# EAGLE schematic Resistor_Resistor (EAGLE 8.3.0), part 8 of 43
## Parts (continued)
R10238  10K  RESISTOR_0201  [0201]
R10239  10K  RESISTOR_0201  [0201]
R10240  10K  RESISTOR_0201  [0201]
R10241  10K  RESISTOR_0201  [0201]
R10242  10K  RESISTOR_0201  [0201]
R10243  10K  RESISTOR_0201  [0201]
R10244  10K  RESISTOR_0201  [0201]
R10245  10K  RESISTOR_0201  [0201]
R10246  10K  RESISTOR_0201  [0201]
R10247  10K  RESISTOR_0201  [0201]
R10248  10K  RESISTOR_0201  [0201]
R10249  10K  RESISTOR_0201  [0201]
R10250  10K  RESISTOR_0201  [0201]
R10251  10K  RESISTOR_0201  [0201]
R10252  10K  RESISTOR_0201  [0201]
R10253  10K  RESISTOR_0201  [0201]
R10254  10K  RESISTOR_0201  [0201]
R10255  10K  RESISTOR_0201  [0201]
R10256  10K  RESISTOR_0201  [0201]
R10257  10K  RESISTOR_0201  [0201]
R10258  10K  RESISTOR_0201  [0201]
R10259  10K  RESISTOR_0201  [0201]
R10260  10K  RESISTOR_0201  [0201]
R10261  10K  RESISTOR_0201  [0201]
R10262  10K  RESISTOR_0201  [0201]
R10263  10K  RESISTOR_0201  [0201]
R10264  10K  RESISTOR_0201  [0201]
R10265  10K  RESISTOR_0201  [0201]
R10266  10K  RESISTOR_0201  [0201]
R10267  10K  RESISTOR_0201  [0201]
R10268  10K  RESISTOR_0201  [0201]
R10269  10K  RESISTOR_0201  [0201]
R10270  10K  RESISTOR_0201  [0201]
R10271  10K  RESISTOR_0201  [0201]
R10272  10K  RESISTOR_0201  [0201]
R10273  10K  RESISTOR_0201  [0201]
R10274  10K  RESISTOR_0201  [0201]
R10275  10K  RESISTOR_0201  [0201]
R10276  10K  RESISTOR_0201  [0201]
R10277  10K  RESISTOR_0201  [0201]
R10278  10K  RESISTOR_0201  [0201]
R10279  10K  RESISTOR_0201  [0201]
R10280  10K  RESISTOR_0201  [0201]
R10281  10K  RESISTOR_0201  [0201]
R10282  10K  RESISTOR_0201  [0201]
R10283  10K  RESISTOR_0201  [0201]
R10284  10K  RESISTOR_0201  [0201]
R10285  10K  RESISTOR_0201  [0201]
R10286  10K  RESISTOR_0201  [0201]
R10287  10K  RESISTOR_0201  [0201]
R10288  10K  RESISTOR_0201  [0201]
R10289  10K  RESISTOR_0201  [0201]
R10290  10K  RESISTOR_0201  [0201]
R10291  10K  RESISTOR_0201  [0201]
R10292  10K  RESISTOR_0201  [0201]
R10293  10K  RESISTOR_0201  [0201]
R10294  10K  RESISTOR_0201  [0201]
R10295  10K  RESISTOR_0201  [0201]
R10296  10K  RESISTOR_0201  [0201]
R10297  10K  RESISTOR_0201  [0201]
R10298  10K  RESISTOR_0201  [0201]
R10299  10K  RESISTOR_0201  [0201]
R10300  10K  RESISTOR_0201  [0201]
R10301  10K  RESISTOR_0201  [0201]
R10302  10K  RESISTOR_0201  [0201]
R10303  10K  RESISTOR_0201  [0201]
R10304  10K  RESISTOR_0201  [0201]
R10305  10K  RESISTOR_0201  [0201]
R10306  10K  RESISTOR_0201  [0201]
R10307  10K  RESISTOR_0201  [0201]
R10308  10K  RESISTOR_0201  [0201]
R10309  10K  RESISTOR_0201  [0201]
R10310  10K  RESISTOR_0201  [0201]
R10311  10K  RESISTOR_0201  [0201]
R10312  10K  RESISTOR_0201  [0201]
R10313  10K  RESISTOR_0201  [0201]
R10314  10K  RESISTOR_0201  [0201]
R10315  10K  RESISTOR_0201  [0201]
R10316  10K  RESISTOR_0201  [0201]
R10317  10K  RESISTOR_0201  [0201]
R10318  10K  RESISTOR_0201  [0201]
R10319  10K  RESISTOR_0201  [0201]
R10320  10K  RESISTOR_0201  [0201]
R10321  10K  RESISTOR_0201  [0201]
R10322  10K  RESISTOR_0201  [0201]
R10323  10K  RESISTOR_0201  [0201]
R10324  10K  RESISTOR_0201  [0201]
R10325  10K  RESISTOR_0201  [0201]
R10326  10K  RESISTOR_0201  [0201]
R10327  10K  RESISTOR_0201  [0201]
R10328  10K  RESISTOR_0201  [0201]
R10329  10K  RESISTOR_0201  [0201]
R10330  10K  RESISTOR_0201  [0201]
R10331  10K  RESISTOR_0201  [0201]
R10332  10K  RESISTOR_0201  [0201]
R10333  10K  RESISTOR_0201  [0201]
R10334  10K  RESISTOR_0201  [0201]
R10335  10K  RESISTOR_0201  [0201]
R10336  10K  RESISTOR_0201  [0201]
R10337  10K  RESISTOR_0201  [0201]
R10338  10K  RESISTOR_0201  [0201]
R10339  10K  RESISTOR_0201  [0201]
R10340  10K  RESISTOR_0201  [0201]
R10341  10K  RESISTOR_0201  [0201]
R10342  10K  RESISTOR_0201  [0201]
R10343  10K  RESISTOR_0201  [0201]
R10344  10K  RESISTOR_0201  [0201]
R10345  10K  RESISTOR_0201  [0201]
R10346  10K  RESISTOR_0201  [0201]
R10347  10K  RESISTOR_0201  [0201]
R10348  10K  RESISTOR_0201  [0201]
R10349  10K  RESISTOR_0201  [0201]
R10350  10K  RESISTOR_0201  [0201]
R10351  10K  RESISTOR_0201  [0201]
R10352  10K  RESISTOR_0201  [0201]
R10353  10K  RESISTOR_0201  [0201]
R10354  10K  RESISTOR_0201  [0201]
R10355  10K  RESISTOR_0201  [0201]
R10356  10K  RESISTOR_0201  [0201]
R10357  10K  RESISTOR_0201  [0201]
R10358  10K  RESISTOR_0201  [0201]
R10359  10K  RESISTOR_0201  [0201]
R10360  10K  RESISTOR_0201  [0201]
R10361  10K  RESISTOR_0201  [0201]
R10362  10K  RESISTOR_0201  [0201]
R10363  10K  RESISTOR_0201  [0201]
R10364  10K  RESISTOR_0201  [0201]
R10365  10K  RESISTOR_0201  [0201]
R10366  10K  RESISTOR_0201  [0201]
R10367  10K  RESISTOR_0201  [0201]
R10368  10K  RESISTOR_0201  [0201]
R10369  10K  RESISTOR_0201  [0201]
R10370  10K  RESISTOR_0201  [0201]
R10371  10K  RESISTOR_0201  [0201]
R10372  10K  RESISTOR_0201  [0201]
R10373  10K  RESISTOR_0201  [0201]
R10374  10K  RESISTOR_0201  [0201]
R10375  10K  RESISTOR_0201  [0201]
R10376  10K  RESISTOR_0201  [0201]
R10377  10K  RESISTOR_0201  [0201]
R10378  10K  RESISTOR_0201  [0201]
R10379  10K  RESISTOR_0201  [0201]
R10380  10K  RESISTOR_0201  [0201]
R10381  10K  RESISTOR_0201  [0201]
R10382  10K  RESISTOR_0201  [0201]
R10383  10K  RESISTOR_0201  [0201]
R10384  10K  RESISTOR_0201  [0201]
R10385  10K  RESISTOR_0201  [0201]
R10386  10K  RESISTOR_0201  [0201]
R10387  10K  RESISTOR_0201  [0201]
R10388  10K  RESISTOR_0201  [0201]
R10389  10K  RESISTOR_0201  [0201]
R10390  10K  RESISTOR_0201  [0201]
R10391  10K  RESISTOR_0201  [0201]
R10392  10K  RESISTOR_0201  [0201]
R10393  10K  RESISTOR_0201  [0201]
R10394  10K  RESISTOR_0201  [0201]
R10395  10K  RESISTOR_0201  [0201]
R10396  10K  RESISTOR_0201  [0201]
R10397  10K  RESISTOR_0201  [0201]
R10398  10K  RESISTOR_0201  [0201]
R10399  10K  RESISTOR_0201  [0201]
R10400  10K  RESISTOR_0201  [0201]
R10401  10K  RESISTOR_0201  [0201]
R10402  10K  RESISTOR_0201  [0201]
R10403  10K  RESISTOR_0201  [0201]
R10404  10K  RESISTOR_0201  [0201]
R10405  10K  RESISTOR_0201  [0201]
R10406  10K  RESISTOR_0201  [0201]
R10407  10K  RESISTOR_0201  [0201]
R10408  10K  RESISTOR_0201  [0201]
R10409  10K  RESISTOR_0201  [0201]
R10410  10K  RESISTOR_0201  [0201]
R10411  10K  RESISTOR_0201  [0201]
R10412  10K  RESISTOR_0201  [0201]
R10413  10K  RESISTOR_0201  [0201]
R10414  10K  RESISTOR_0201  [0201]
R10415  10K  RESISTOR_0201  [0201]
R10416  10K  RESISTOR_0201  [0201]
R10417  10K  RESISTOR_0201  [0201]
R10418  10K  RESISTOR_0201  [0201]
R10419  10K  RESISTOR_0201  [0201]
R10420  10K  RESISTOR_0201  [0201]
R10421  10K  RESISTOR_0201  [0201]
R10422  10K  RESISTOR_0201  [0201]
R10423  10K  RESISTOR_0201  [0201]
R10424  10K  RESISTOR_0201  [0201]
R10425  10K  RESISTOR_0201  [0201]
R10426  10K  RESISTOR_0201  [0201]
R10427  10K  RESISTOR_0201  [0201]
R10428  10K  RESISTOR_0201  [0201]
R10429  10K  RESISTOR_0201  [0201]
R10430  10K  RESISTOR_0201  [0201]
R10431  10K  RESISTOR_0201  [0201]
R10432  10K  RESISTOR_0201  [0201]
R10433  10K  RESISTOR_0201  [0201]
R10434  10K  RESISTOR_0201  [0201]
R10435  10K  RESISTOR_0201  [0201]
R10436  10K  RESISTOR_0201  [0201]
R10437  10K  RESISTOR_0201  [0201]
R10438  10K  RESISTOR_0201  [0201]
R10439  10K  RESISTOR_0201  [0201]
R10440  10K  RESISTOR_0201  [0201]
R10441  10K  RESISTOR_0201  [0201]
R10442  10K  RESISTOR_0201  [0201]
R10443  10K  RESISTOR_0201  [0201]
R10444  10K  RESISTOR_0201  [0201]
R10445  10K  RESISTOR_0201  [0201]
R10446  10K  RESISTOR_0201  [0201]
R10447  10K  RESISTOR_0201  [0201]
R10448  10K  RESISTOR_0201  [0201]
R10449  10K  RESISTOR_0201  [0201]
R10450  10K  RESISTOR_0201  [0201]
R10451  10K  RESISTOR_0201  [0201]
R10452  10K  RESISTOR_0201  [0201]
R10453  10K  RESISTOR_0201  [0201]
R10454  10K  RESISTOR_0201  [0201]
R10455  10K  RESISTOR_0201  [0201]
R10456  10K  RESISTOR_0201  [0201]
R10457  10K  RESISTOR_0201  [0201]
R10458  10K  RESISTOR_0201  [0201]
R10459  10K  RESISTOR_0201  [0201]
R10460  10K  RESISTOR_0201  [0201]
R10461  10K  RESISTOR_0201  [0201]
R10462  10K  RESISTOR_0201  [0201]
R10463  10K  RESISTOR_0201  [0201]
R10464  10K  RESISTOR_0201  [0201]
R10465  10K  RESISTOR_0201  [0201]
R10466  10K  RESISTOR_0201  [0201]
R10467  10K  RESISTOR_0201  [0201]
R10468  10K  RESISTOR_0201  [0201]
R10469  10K  RESISTOR_0201  [0201]
R10470  10K  RESISTOR_0201  [0201]
R10471  10K  RESISTOR_0201  [0201]
R10472  10K  RESISTOR_0201  [0201]
R10473  10K  RESISTOR_0201  [0201]
R10474  10K  RESISTOR_0201  [0201]
R10475  10K  RESISTOR_0201  [0201]
R10476  10K  RESISTOR_0201  [0201]
R10477  10K  RESISTOR_0201  [0201]
R10478  10K  RESISTOR_0201  [0201]
R10479  10K  RESISTOR_0201  [0201]
R10480  10K  RESISTOR_0201  [0201]
R10481  10K  RESISTOR_0201  [0201]
R10482  10K  RESISTOR_0201  [0201]
R10483  10K  RESISTOR_0201  [0201]
R10484  10K  RESISTOR_0201  [0201]
R10485  10K  RESISTOR_0201  [0201]
R10486  10K  RESISTOR_0201  [0201]
R10487  10K  RESISTOR_0201  [0201]
R10488  10K  RESISTOR_0201  [0201]
R10489  10K  RESISTOR_0201  [0201]
R10490  10K  RESISTOR_0201  [0201]
R10491  10K  RESISTOR_0201  [0201]
R10492  10K  RESISTOR_0201  [0201]
R10493  10K  RESISTOR_0201  [0201]
R10494  10K  RESISTOR_0201  [0201]
R10495  10K  RESISTOR_0201  [0201]
R10496  10K  RESISTOR_0201  [0201]
R10497  10K  RESISTOR_0201  [0201]
R10498  10K  RESISTOR_0201  [0201]
R10499  10K  RESISTOR_0201  [0201]
R10500  10K  RESISTOR_0201  [0201]
R10501  10K  RESISTOR_0201  [0201]
R10502  10K  RESISTOR_0201  [0201]
R10503  10K  RESISTOR_0201  [0201]
R10504  10K  RESISTOR_0201  [0201]
R10505  10K  RESISTOR_0201  [0201]
R10506  10K  RESISTOR_0201  [0201]
R10507  10K  RESISTOR_0201  [0201]
R10508  10K  RESISTOR_0201  [0201]
R10509  10K  RESISTOR_0201  [0201]
R10510  10K  RESISTOR_0201  [0201]
R10511  10K  RESISTOR_0201  [0201]
R10512  10K  RESISTOR_0201  [0201]
R10513  10K  RESISTOR_0201  [0201]
R10514  10K  RESISTOR_0201  [0201]
R10515  10K  RESISTOR_0201  [0201]
R10516  10K  RESISTOR_0201  [0201]
R10517  10K  RESISTOR_0201  [0201]
R10518  10K  RESISTOR_0201  [0201]
R10519  10K  RESISTOR_0201  [0201]
R10520  10K  RESISTOR_0201  [0201]
R10521  10K  RESISTOR_0201  [0201]
R10522  10K  RESISTOR_0201  [0201]
R10523  10K  RESISTOR_0201  [0201]
R10524  10K  RESISTOR_0201  [0201]
R10525  10K  RESISTOR_0201  [0201]
R10526  10K  RESISTOR_0201  [0201]
R10527  10K  RESISTOR_0201  [0201]
R10528  10K  RESISTOR_0201  [0201]
R10529  10K  RESISTOR_0201  [0201]
R10530  10K  RESISTOR_0201  [0201]
R10531  10K  RESISTOR_0201  [0201]
R10532  10K  RESISTOR_0201  [0201]
R10533  10K  RESISTOR_0201  [0201]
R10534  10K  RESISTOR_0201  [0201]
R10535  10K  RESISTOR_0201  [0201]
R10536  10K  RESISTOR_0201  [0201]
R10537  10K  RESISTOR_0201  [0201]
R10538  10K  RESISTOR_0201  [0201]
R10539  10K  RESISTOR_0201  [0201]
R10540  10K  RESISTOR_0201  [0201]
R10541  10K  RESISTOR_0201  [0201]
R10542  10K  RESISTOR_0201  [0201]
R10543  10K  RESISTOR_0201  [0201]
R10544  10K  RESISTOR_0201  [0201]
R10545  10K  RESISTOR_0201  [0201]
R10546  10K  RESISTOR_0201  [0201]
R10547  10K  RESISTOR_0201  [0201]
R10548  10K  RESISTOR_0201  [0201]
R10549  10K  RESISTOR_0201  [0201]
R10550  10K  RESISTOR_0201  [0201]
R10551  10K  RESISTOR_0201  [0201]
R10552  10K  RESISTOR_0201  [0201]
R10553  10K  RESISTOR_0201  [0201]
R10554  10K  RESISTOR_0201  [0201]
R10555  10K  RESISTOR_0201  [0201]
R10556  10K  RESISTOR_0201  [0201]
R10557  10K  RESISTOR_0201  [0201]
R10558  10K  RESISTOR_0201  [0201]
R10559  10K  RESISTOR_0201  [0201]
R10560  10K  RESISTOR_0201  [0201]
R10561  10K  RESISTOR_0201  [0201]
R10562  10K  RESISTOR_0201  [0201]
R10563  10K  RESISTOR_0201  [0201]
R10564  10K  RESISTOR_0201  [0201]
R10565  10K  RESISTOR_0201  [0201]
R10566  10K  RESISTOR_0201  [0201]
R10567  10K  RESISTOR_0201  [0201]
R10568  10K  RESISTOR_0201  [0201]
R10569  10K  RESISTOR_0201  [0201]
R10570  10K  RESISTOR_0201  [0201]
R10571  10K  RESISTOR_0201  [0201]
R10572  10K  RESISTOR_0201  [0201]
R10573  10K  RESISTOR_0201  [0201]
R10574  10K  RESISTOR_0201  [0201]
R10575  10K  RESISTOR_0201  [0201]
R10576  10K  RESISTOR_0201  [0201]
R10577  10K  RESISTOR_0201  [0201]
R10578  10K  RESISTOR_0201  [0201]
R10579  10K  RESISTOR_0201  [0201]
R10580  10K  RESISTOR_0201  [0201]
R10581  10K  RESISTOR_0201  [0201]
R10582  10K  RESISTOR_0201  [0201]
R10583  10K  RESISTOR_0201  [0201]
R10584  10K  RESISTOR_0201  [0201]
R10585  10K  RESISTOR_0201  [0201]
R10586  10K  RESISTOR_0201  [0201]
R10587  10K  RESISTOR_0201  [0201]
R10588  10K  RESISTOR_0201  [0201]
R10589  10K  RESISTOR_0201  [0201]
R10590  10K  RESISTOR_0201  [0201]
R10591  10K  RESISTOR_0201  [0201]
R10592  10K  RESISTOR_0201  [0201]
R10593  10K  RESISTOR_0201  [0201]
R10594  10K  RESISTOR_0201  [0201]
R10595  10K  RESISTOR_0201  [0201]
R10596  10K  RESISTOR_0201  [0201]
R10597  10K  RESISTOR_0201  [0201]
R10598  10K  RESISTOR_0201  [0201]
R10599  10K  RESISTOR_0201  [0201]
R10600  10K  RESISTOR_0201  [0201]
R10601  10K  RESISTOR_0201  [0201]
R10602  10K  RESISTOR_0201  [0201]
R10603  10K  RESISTOR_0201  [0201]
R10604  10K  RESISTOR_0201  [0201]
R10605  10K  RESISTOR_0201  [0201]
R10606  10K  RESISTOR_0201  [0201]
R10607  10K  RESISTOR_0201  [0201]
R10608  10K  RESISTOR_0201  [0201]
R10609  10K  RESISTOR_0201  [0201]
R10610  10K  RESISTOR_0201  [0201]
R10611  10K  RESISTOR_0201  [0201]
R10612  10K  RESISTOR_0201  [0201]
R10613  10K  RESISTOR_0201  [0201]
R10614  10K  RESISTOR_0201  [0201]
R10615  10K  RESISTOR_0201  [0201]
R10616  10K  RESISTOR_0201  [0201]
R10617  10K  RESISTOR_0201  [0201]
R10618  10K  RESISTOR_0201  [0201]
R10619  10K  RESISTOR_0201  [0201]
R10620  10K  RESISTOR_0201  [0201]
R10621  10K  RESISTOR_0201  [0201]
R10622  10K  RESISTOR_0201  [0201]
R10623  10K  RESISTOR_0201  [0201]
R10624  10K  RESISTOR_0201  [0201]
R10625  10K  RESISTOR_0201  [0201]
R10626  10K  RESISTOR_0201  [0201]
R10627  10K  RESISTOR_0201  [0201]
R10628  10K  RESISTOR_0201  [0201]
R10629  10K  RESISTOR_0201  [0201]
R10630  10K  RESISTOR_0201  [0201]
R10631  10K  RESISTOR_0201  [0201]
R10632  10K  RESISTOR_0201  [0201]
R10633  10K  RESISTOR_0201  [0201]
R10634  10K  RESISTOR_0201  [0201]
R10635  10K  RESISTOR_0201  [0201]
R10636  10K  RESISTOR_0201  [0201]
R10637  10K  RESISTOR_0201  [0201]
R10638  10K  RESISTOR_0201  [0201]
R10639  10K  RESISTOR_0201  [0201]
R10640  10K  RESISTOR_0201  [0201]
R10641  10K  RESISTOR_0201  [0201]
R10642  10K  RESISTOR_0201  [0201]
R10643  10K  RESISTOR_0201  [0201]
R10644  10K  RESISTOR_0201  [0201]
R10645  10K  RESISTOR_0201  [0201]
R10646  10K  RESISTOR_0201  [0201]
R10647  10K  RESISTOR_0201  [0201]
R10648  10K  RESISTOR_0201  [0201]
R10649  10K  RESISTOR_0201  [0201]
R10650  10K  RESISTOR_0201  [0201]
R10651  10K  RESISTOR_0201  [0201]
R10652  10K  RESISTOR_0201  [0201]
R10653  10K  RESISTOR_0201  [0201]
R10654  10K  RESISTOR_0201  [0201]
R10655  10K  RESISTOR_0201  [0201]
R10656  10K  RESISTOR_0201  [0201]
R10657  10K  RESISTOR_0201  [0201]
R10658  10K  RESISTOR_0201  [0201]
R10659  10K  RESISTOR_0201  [0201]
R10660  10K  RESISTOR_0201  [0201]
R10661  10K  RESISTOR_0201  [0201]
R10662  10K  RESISTOR_0201  [0201]
R10663  10K  RESISTOR_0201  [0201]
R10664  10K  RESISTOR_0201  [0201]
R10665  10K  RESISTOR_0201  [0201]
R10666  10K  RESISTOR_0201  [0201]
R10667  10K  RESISTOR_0201  [0201]
R10668  10K  RESISTOR_0201  [0201]
R10669  10K  RESISTOR_0201  [0201]
R10670  10K  RESISTOR_0201  [0201]
R10671  10K  RESISTOR_0201  [0201]
R10672  10K  RESISTOR_0201  [0201]
R10673  10K  RESISTOR_0201  [0201]
R10674  10K  RESISTOR_0201  [0201]
R10675  10K  RESISTOR_0201  [0201]
R10676  10K  RESISTOR_0201  [0201]
R10677  10K  RESISTOR_0201  [0201]
R10678  10K  RESISTOR_0201  [0201]
R10679  10K  RESISTOR_0201  [0201]
R10680  10K  RESISTOR_0201  [0201]
R10681  10K  RESISTOR_0201  [0201]
R10682  10K  RESISTOR_0201  [0201]
R10683  10K  RESISTOR_0201  [0201]
R10684  10K  RESISTOR_0201  [0201]
R10685  10K  RESISTOR_0201  [0201]
R10686  10K  RESISTOR_0201  [0201]
R10687  10K  RESISTOR_0201  [0201]
R10688  10K  RESISTOR_0201  [0201]
R10689  10K  RESISTOR_0201  [0201]
R10690  10K  RESISTOR_0201  [0201]
R10691  10K  RESISTOR_0201  [0201]
R10692  10K  RESISTOR_0201  [0201]
R10693  10K  RESISTOR_0201  [0201]
R10694  10K  RESISTOR_0201  [0201]
R10695  10K  RESISTOR_0201  [0201]
R10696  10K  RESISTOR_0201  [0201]
R10697  10K  RESISTOR_0201  [0201]
R10698  10K  RESISTOR_0201  [0201]
R10699  10K  RESISTOR_0201  [0201]
R10700  10K  RESISTOR_0201  [0201]
R10701  10K  RESISTOR_0201  [0201]
R10702  10K  RESISTOR_0201  [0201]
R10703  10K  RESISTOR_0201  [0201]
R10704  10K  RESISTOR_0201  [0201]
R10705  10K  RESISTOR_0201  [0201]
R10706  10K  RESISTOR_0201  [0201]
R10707  10K  RESISTOR_0201  [0201]
R10708  10K  RESISTOR_0201  [0201]
R10709  10K  RESISTOR_0201  [0201]
R10710  10K  RESISTOR_0201  [0201]
R10711  10K  RESISTOR_0201  [0201]
R10712  10K  RESISTOR_0201  [0201]
R10713  10K  RESISTOR_0201  [0201]
R10714  10K  RESISTOR_0201  [0201]
R10715  10K  RESISTOR_0201  [0201]
R10716  10K  RESISTOR_0201  [0201]
R10717  10K  RESISTOR_0201  [0201]
R10718  10K  RESISTOR_0201  [0201]
R10719  10K  RESISTOR_0201  [0201]
R10720  10K  RESISTOR_0201  [0201]
R10721  10K  RESISTOR_0201  [0201]
R10722  10K  RESISTOR_0201  [0201]
R10723  10K  RESISTOR_0201  [0201]
R10724  10K  RESISTOR_0201  [0201]
R10725  10K  RESISTOR_0201  [0201]
R10726  10K  RESISTOR_0201  [0201]
R10727  10K  RESISTOR_0201  [0201]
R10728  10K  RESISTOR_0201  [0201]
R10729  10K  RESISTOR_0201  [0201]
R10730  10K  RESISTOR_0201  [0201]
R10731  10K  RESISTOR_0201  [0201]
R10732  10K  RESISTOR_0201  [0201]
R10733  10K  RESISTOR_0201  [0201]
R10734  10K  RESISTOR_0201  [0201]
R10735  10K  RESISTOR_0201  [0201]
R10736  10K  RESISTOR_0201  [0201]
R10737  10K  RESISTOR_0201  [0201]
R10738  10K  RESISTOR_0201  [0201]
R10739  10K  RESISTOR_0201  [0201]
R10740  10K  RESISTOR_0201  [0201]
R10741  10K  RESISTOR_0201  [0201]
R10742  10K  RESISTOR_0201  [0201]
R10743  10K  RESISTOR_0201  [0201]
R10744  10K  RESISTOR_0201  [0201]
R10745  10K  RESISTOR_0201  [0201]
R10746  10K  RESISTOR_0201  [0201]
R10747  10K  RESISTOR_0201  [0201]
R10748  10K  RESISTOR_0201  [0201]
R10749  10K  RESISTOR_0201  [0201]
R10750  10K  RESISTOR_0201  [0201]
R10751  10K  RESISTOR_0201  [0201]
R10752  10K  RESISTOR_0201  [0201]
R10753  10K  RESISTOR_0201  [0201]
R10754  10K  RESISTOR_0201  [0201]
R10755  10K  RESISTOR_0201  [0201]
R10756  10K  RESISTOR_0201  [0201]
R10757  10K  RESISTOR_0201  [0201]
R10758  10K  RESISTOR_0201  [0201]
R10759  10K  RESISTOR_0201  [0201]
R10760  10K  RESISTOR_0201  [0201]
R10761  10K  RESISTOR_0201  [0201]
R10762  10K  RESISTOR_0201  [0201]
R10763  10K  RESISTOR_0201  [0201]
R10764  10K  RESISTOR_0201  [0201]
R10765  10K  RESISTOR_0201  [0201]
R10766  10K  RESISTOR_0201  [0201]
R10767  10K  RESISTOR_0201  [0201]
R10768  10K  RESISTOR_0201  [0201]
R10769  10K  RESISTOR_0201  [0201]
R10770  10K  RESISTOR_0201  [0201]
R10771  10K  RESISTOR_0201  [0201]
R10772  10K  RESISTOR_0201  [0201]
R10773  10K  RESISTOR_0201  [0201]
R10774  10K  RESISTOR_0201  [0201]
R10775  10K  RESISTOR_0201  [0201]
R10776  10K  RESISTOR_0201  [0201]
R10777  10K  RESISTOR_0201  [0201]
R10778  10K  RESISTOR_0201  [0201]
R10779  10K  RESISTOR_0201  [0201]
R10780  10K  RESISTOR_0201  [0201]
R10781  10K  RESISTOR_0201  [0201]
R10782  10K  RESISTOR_0201  [0201]
R10783  10K  RESISTOR_0201  [0201]
R10784  10K  RESISTOR_0201  [0201]
R10785  10K  RESISTOR_0201  [0201]
R10786  10K  RESISTOR_0201  [0201]
R10787  10K  RESISTOR_0201  [0201]
R10788  10K  RESISTOR_0201  [0201]
R10789  10K  RESISTOR_0201  [0201]
R10790  10K  RESISTOR_0201  [0201]
R10791  10K  RESISTOR_0201  [0201]
R10792  10K  RESISTOR_0201  [0201]
R10793  10K  RESISTOR_0201  [0201]
R10794  10K  RESISTOR_0201  [0201]
R10795  10K  RESISTOR_0201  [0201]
R10796  10K  RESISTOR_0201  [0201]
R10797  10K  RESISTOR_0201  [0201]
R10798  10K  RESISTOR_0201  [0201]
R10799  10K  RESISTOR_0201  [0201]
R10800  10K  RESISTOR_0201  [0201]
R10801  10K  RESISTOR_0201  [0201]
R10802  10K  RESISTOR_0201  [0201]
R10803  10K  RESISTOR_0201  [0201]
R10804  10K  RESISTOR_0201  [0201]
R10805  10K  RESISTOR_0201  [0201]
R10806  10K  RESISTOR_0201  [0201]
R10807  10K  RESISTOR_0201  [0201]
R10808  10K  RESISTOR_0201  [0201]
R10809  10K  RESISTOR_0201  [0201]
R10810  10K  RESISTOR_0201  [0201]
R10811  10K  RESISTOR_0201  [0201]
R10812  10K  RESISTOR_0201  [0201]
R10813  10K  RESISTOR_0201  [0201]
R10814  10K  RESISTOR_0201  [0201]
R10815  10K  RESISTOR_0201  [0201]
R10816  10K  RESISTOR_0201  [0201]
R10817  10K  RESISTOR_0201  [0201]
R10818  10K  RESISTOR_0201  [0201]
R10819  10K  RESISTOR_0201  [0201]
R10820  10K  RESISTOR_0201  [0201]
R10821  10K  RESISTOR_0201  [0201]
R10822  10K  RESISTOR_0201  [0201]
R10823  10K  RESISTOR_0201  [0201]
R10824  10K  RESISTOR_0201  [0201]
R10825  10K  RESISTOR_0201  [0201]
R10826  10K  RESISTOR_0201  [0201]
R10827  10K  RESISTOR_0201  [0201]
R10828  10K  RESISTOR_0201  [0201]
R10829  10K  RESISTOR_0201  [0201]
R10830  10K  RESISTOR_0201  [0201]
R10831  10K  RESISTOR_0201  [0201]
R10832  10K  RESISTOR_0201  [0201]
R10833  10K  RESISTOR_0201  [0201]
R10834  10K  RESISTOR_0201  [0201]
R10835  10K  RESISTOR_0201  [0201]
R10836  10K  RESISTOR_0201  [0201]
R10837  10K  RESISTOR_0201  [0201]
R10838  10K  RESISTOR_0201  [0201]
R10839  10K  RESISTOR_0201  [0201]
R10840  10K  RESISTOR_0201  [0201]
R10841  10K  RESISTOR_0201  [0201]
R10842  10K  RESISTOR_0201  [0201]
R10843  10K  RESISTOR_0201  [0201]
R10844  10K  RESISTOR_0201  [0201]
R10845  10K  RESISTOR_0201  [0201]
R10846  10K  RESISTOR_0201  [0201]
R10847  10K  RESISTOR_0201  [0201]
R10848  10K  RESISTOR_0201  [0201]
R10849  10K  RESISTOR_0201  [0201]
R10850  10K  RESISTOR_0201  [0201]
R10851  10K  RESISTOR_0201  [0201]
R10852  10K  RESISTOR_0201  [0201]
R10853  10K  RESISTOR_0201  [0201]
R10854  10K  RESISTOR_0201  [0201]
R10855  10K  RESISTOR_0201  [0201]
R10856  10K  RESISTOR_0201  [0201]
R10857  10K  RESISTOR_0201  [0201]
R10858  10K  RESISTOR_0201  [0201]
R10859  10K  RESISTOR_0201  [0201]
R10860  10K  RESISTOR_0201  [0201]
R10861  10K  RESISTOR_0201  [0201]
R10862  10K  RESISTOR_0201  [0201]
R10863  10K  RESISTOR_0201  [0201]
R10864  10K  RESISTOR_0201  [0201]
R10865  10K  RESISTOR_0201  [0201]
R10866  10K  RESISTOR_0201  [0201]
R10867  10K  RESISTOR_0201  [0201]
R10868  10K  RESISTOR_0201  [0201]
R10869  10K  RESISTOR_0201  [0201]
R10870  10K  RESISTOR_0201  [0201]
R10871  10K  RESISTOR_0201  [0201]
R10872  10K  RESISTOR_0201  [0201]
R10873  10K  RESISTOR_0201  [0201]
R10874  10K  RESISTOR_0201  [0201]
R10875  10K  RESISTOR_0201  [0201]
R10876  10K  RESISTOR_0201  [0201]
R10877  10K  RESISTOR_0201  [0201]
R10878  10K  RESISTOR_0201  [0201]
R10879  10K  RESISTOR_0201  [0201]
R10880  10K  RESISTOR_0201  [0201]
R10881  10K  RESISTOR_0201  [0201]
R10882  10K  RESISTOR_0201  [0201]
R10883  10K  RESISTOR_0201  [0201]
R10884  10K  RESISTOR_0201  [0201]
R10885  10K  RESISTOR_0201  [0201]
R10886  10K  RESISTOR_0201  [0201]
R10887  10K  RESISTOR_0201  [0201]
R10888  10K  RESISTOR_0201  [0201]
R10889  10K  RESISTOR_0201  [0201]
R10890  10K  RESISTOR_0201  [0201]
R10891  10K  RESISTOR_0201  [0201]
R10892  10K  RESISTOR_0201  [0201]
R10893  10K  RESISTOR_0201  [0201]
R10894  10K  RESISTOR_0201  [0201]
R10895  10K  RESISTOR_0201  [0201]
R10896  10K  RESISTOR_0201  [0201]
R10897  10K  RESISTOR_0201  [0201]
R10898  10K  RESISTOR_0201  [0201]
R10899  10K  RESISTOR_0201  [0201]
R10900  10K  RESISTOR_0201  [0201]
R10901  10K  RESISTOR_0201  [0201]
R10902  10K  RESISTOR_0201  [0201]
R10903  10K  RESISTOR_0201  [0201]
R10904  10K  RESISTOR_0201  [0201]
R10905  10K  RESISTOR_0201  [0201]
R10906  10K  RESISTOR_0201  [0201]
R10907  10K  RESISTOR_0201  [0201]
R10908  10K  RESISTOR_0201  [0201]
R10909  10K  RESISTOR_0201  [0201]
R10910  10K  RESISTOR_0201  [0201]
R10911  10K  RESISTOR_0201  [0201]
R10912  10K  RESISTOR_0201  [0201]
R10913  10K  RESISTOR_0201  [0201]
R10914  10K  RESISTOR_0201  [0201]
R10915  10K  RESISTOR_0201  [0201]
R10916  10K  RESISTOR_0201  [0201]
R10917  10K  RESISTOR_0201  [0201]
R10918  10K  RESISTOR_0201  [0201]
R10919  10K  RESISTOR_0201  [0201]
R10920  10K  RESISTOR_0201  [0201]
R10921  10K  RESISTOR_0201  [0201]
R10922  10K  RESISTOR_0201  [0201]
R10923  10K  RESISTOR_0201  [0201]
R10924  10K  RESISTOR_0201  [0201]
R10925  10K  RESISTOR_0201  [0201]
R10926  10K  RESISTOR_0201  [0201]
R10927  10K  RESISTOR_0201  [0201]
R10928  10K  RESISTOR_0201  [0201]
R10929  10K  RESISTOR_0201  [0201]
R10930  10K  RESISTOR_0201  [0201]
R10931  10K  RESISTOR_0201  [0201]
R10932  10K  RESISTOR_0201  [0201]
R10933  10K  RESISTOR_0201  [0201]
R10934  10K  RESISTOR_0201  [0201]
R10935  10K  RESISTOR_0201  [0201]
R10936  10K  RESISTOR_0201  [0201]
R10937  10K  RESISTOR_0201  [0201]
R10938  10K  RESISTOR_0201  [0201]
R10939  10K  RESISTOR_0201  [0201]
R10940  10K  RESISTOR_0201  [0201]
R10941  10K  RESISTOR_0201  [0201]
R10942  10K  RESISTOR_0201  [0201]
R10943  10K  RESISTOR_0201  [0201]
R10944  10K  RESISTOR_0201  [0201]
R10945  10K  RESISTOR_0201  [0201]
R10946  10K  RESISTOR_0201  [0201]
R10947  10K  RESISTOR_0201  [0201]
R10948  10K  RESISTOR_0201  [0201]
R10949  10K  RESISTOR_0201  [0201]
R10950  10K  RESISTOR_0201  [0201]
R10951  10K  RESISTOR_0201  [0201]
R10952  10K  RESISTOR_0201  [0201]
R10953  10K  RESISTOR_0201  [0201]
R10954  10K  RESISTOR_0201  [0201]
R10955  10K  RESISTOR_0201  [0201]
R10956  10K  RESISTOR_0201  [0201]
R10957  10K  RESISTOR_0201  [0201]
R10958  10K  RESISTOR_0201  [0201]
R10959  10K  RESISTOR_0201  [0201]
R10960  10K  RESISTOR_0201  [0201]
R10961  10K  RESISTOR_0201  [0201]
R10962  10K  RESISTOR_0201  [0201]
R10963  10K  RESISTOR_0201  [0201]
R10964  10K  RESISTOR_0201  [0201]
R10965  10K  RESISTOR_0201  [0201]
R10966  10K  RESISTOR_0201  [0201]
R10967  10K  RESISTOR_0201  [0201]
R10968  10K  RESISTOR_0201  [0201]
R10969  10K  RESISTOR_0201  [0201]
R10970  10K  RESISTOR_0201  [0201]
R10971  10K  RESISTOR_0201  [0201]
R10972  10K  RESISTOR_0201  [0201]
R10973  10K  RESISTOR_0201  [0201]
R10974  10K  RESISTOR_0201  [0201]
R10975  10K  RESISTOR_0201  [0201]
R10976  10K  RESISTOR_0201  [0201]
R10977  10K  RESISTOR_0201  [0201]
R10978  10K  RESISTOR_0201  [0201]
R10979  10K  RESISTOR_0201  [0201]
R10980  10K  RESISTOR_0201  [0201]
R10981  10K  RESISTOR_0201  [0201]
R10982  10K  RESISTOR_0201  [0201]
R10983  10K  RESISTOR_0201  [0201]
R10984  10K  RESISTOR_0201  [0201]
R10985  10K  RESISTOR_0201  [0201]
R10986  10K  RESISTOR_0201  [0201]
R10987  10K  RESISTOR_0201  [0201]
R10988  10K  RESISTOR_0201  [0201]
R10989  10K  RESISTOR_0201  [0201]
R10990  10K  RESISTOR_0201  [0201]
R10991  10K  RESISTOR_0201  [0201]
R10992  10K  RESISTOR_0201  [0201]
R10993  10K  RESISTOR_0201  [0201]
R10994  10K  RESISTOR_0201  [0201]
R10995  10K  RESISTOR_0201  [0201]
R10996  10K  RESISTOR_0201  [0201]
R10997  10K  RESISTOR_0201  [0201]
R10998  10K  RESISTOR_0201  [0201]
R10999  10K  RESISTOR_0201  [0201]
R11000  10K  RESISTOR_0201  [0201]
R11001  10K  RESISTOR_0201  [0201]
R11002  10K  RESISTOR_0201  [0201]
R11003  10K  RESISTOR_0201  [0201]
R11004  10K  RESISTOR_0201  [0201]
R11005  10K  RESISTOR_0201  [0201]
R11006  10K  RESISTOR_0201  [0201]
R11007  10K  RESISTOR_0201  [0201]
R11008  10K  RESISTOR_0201  [0201]
R11009  10K  RESISTOR_0201  [0201]
R11010  10K  RESISTOR_0201  [0201]
R11011  10K  RESISTOR_0201  [0201]
R11012  10K  RESISTOR_0201  [0201]
R11013  10K  RESISTOR_0201  [0201]
R11014  10K  RESISTOR_0201  [0201]
R11015  10K  RESISTOR_0201  [0201]
R11016  10K  RESISTOR_0201  [0201]
R11017  10K  RESISTOR_0201  [0201]
R11018  10K  RESISTOR_0201  [0201]
R11019  10K  RESISTOR_0201  [0201]
R11020  10K  RESISTOR_0201  [0201]
R11021  10K  RESISTOR_0201  [0201]
R11022  10K  RESISTOR_0201  [0201]
R11023  10K  RESISTOR_0201  [0201]
R11024  10K  RESISTOR_0201  [0201]
R11025  10K  RESISTOR_0201  [0201]
R11026  10K  RESISTOR_0201  [0201]
R11027  10K  RESISTOR_0201  [0201]
R11028  10K  RESISTOR_0201  [0201]
R11029  10K  RESISTOR_0201  [0201]
R11030  10K  RESISTOR_0201  [0201]
R11031  10K  RESISTOR_0201  [0201]
R11032  10K  RESISTOR_0201  [0201]
R11033  10K  RESISTOR_0201  [0201]
R11034  10K  RESISTOR_0201  [0201]
R11035  10K  RESISTOR_0201  [0201]
R11036  10K  RESISTOR_0201  [0201]
R11037  10K  RESISTOR_0201  [0201]
R11038  10K  RESISTOR_0201  [0201]
R11039  10K  RESISTOR_0201  [0201]
R11040  10K  RESISTOR_0201  [0201]
R11041  10K  RESISTOR_0201  [0201]
R11042  10K  RESISTOR_0201  [0201]
R11043  10K  RESISTOR_0201  [0201]
R11044  10K  RESISTOR_0201  [0201]
R11045  10K  RESISTOR_0201  [0201]
R11046  10K  RESISTOR_0201  [0201]
R11047  10K  RESISTOR_0201  [0201]
R11048  10K  RESISTOR_0201  [0201]
R11049  10K  RESISTOR_0201  [0201]
R11050  10K  RESISTOR_0201  [0201]
R11051  10K  RESISTOR_0201  [0201]
R11052  10K  RESISTOR_0201  [0201]
R11053  10K  RESISTOR_0201  [0201]
R11054  10K  RESISTOR_0201  [0201]
R11055  10K  RESISTOR_0201  [0201]
R11056  10K  RESISTOR_0201  [0201]
R11057  10K  RESISTOR_0201  [0201]
R11058  10K  RESISTOR_0201  [0201]
R11059  10K  RESISTOR_0201  [0201]
R11060  10K  RESISTOR_0201  [0201]
R11061  10K  RESISTOR_0201  [0201]
R11062  10K  RESISTOR_0201  [0201]
R11063  10K  RESISTOR_0201  [0201]
R11064  10K  RESISTOR_0201  [0201]
R11065  10K  RESISTOR_0201  [0201]
R11066  10K  RESISTOR_0201  [0201]
R11067  10K  RESISTOR_0201  [0201]
R11068  10K  RESISTOR_0201  [0201]
R11069  10K  RESISTOR_0201  [0201]
R11070  10K  RESISTOR_0201  [0201]
R11071  10K  RESISTOR_0201  [0201]
R11072  10K  RESISTOR_0201  [0201]
R11073  10K  RESISTOR_0201  [0201]
R11074  10K  RESISTOR_0201  [0201]
R11075  10K  RESISTOR_0201  [0201]
R11076  10K  RESISTOR_0201  [0201]
R11077  10K  RESISTOR_0201  [0201]
R11078  10K  RESISTOR_0201  [0201]
R11079  10K  RESISTOR_0201  [0201]
R11080  10K  RESISTOR_0201  [0201]
R11081  10K  RESISTOR_0201  [0201]
R11082  10K  RESISTOR_0201  [0201]
R11083  10K  RESISTOR_0201  [0201]
R11084  10K  RESISTOR_0201  [0201]
R11085  10K  RESISTOR_0201  [0201]
R11086  10K  RESISTOR_0201  [0201]
R11087  10K  RESISTOR_0201  [0201]
R11088  10K  RESISTOR_0201  [0201]
R11089  10K  RESISTOR_0201  [0201]
R11090  10K  RESISTOR_0201  [0201]
R11091  10K  RESISTOR_0201  [0201]
R11092  10K  RESISTOR_0201  [0201]
R11093  10K  RESISTOR_0201  [0201]
R11094  10K  RESISTOR_0201  [0201]
R11095  10K  RESISTOR_0201  [0201]
R11096  10K  RESISTOR_0201  [0201]
R11097  10K  RESISTOR_0201  [0201]
R11098  10K  RESISTOR_0201  [0201]
R11099  10K  RESISTOR_0201  [0201]
R11100  10K  RESISTOR_0201  [0201]
R11101  10K  RESISTOR_0201  [0201]
R11102  10K  RESISTOR_0201  [0201]
R11103  10K  RESISTOR_0201  [0201]
R11104  10K  RESISTOR_0201  [0201]
R11105  10K  RESISTOR_0201  [0201]
R11106  10K  RESISTOR_0201  [0201]
R11107  10K  RESISTOR_0201  [0201]
R11108  10K  RESISTOR_0201  [0201]
R11109  10K  RESISTOR_0201  [0201]
R11110  10K  RESISTOR_0201  [0201]
R11111  10K  RESISTOR_0201  [0201]
R11112  10K  RESISTOR_0201  [0201]
R11113  10K  RESISTOR_0201  [0201]
R11114  10K  RESISTOR_0201  [0201]
R11115  10K  RESISTOR_0201  [0201]
R11116  10K  RESISTOR_0201  [0201]
R11117  10K  RESISTOR_0201  [0201]
R11118  10K  RESISTOR_0201  [0201]
R11119  10K  RESISTOR_0201  [0201]
R11120  10K  RESISTOR_0201  [0201]
R11121  10K  RESISTOR_0201  [0201]
R11122  10K  RESISTOR_0201  [0201]
R11123  10K  RESISTOR_0201  [0201]
R11124  10K  RESISTOR_0201  [0201]
R11125  10K  RESISTOR_0201  [0201]
R11126  10K  RESISTOR_0201  [0201]
R11127  10K  RESISTOR_0201  [0201]
R11128  10K  RESISTOR_0201  [0201]
R11129  10K  RESISTOR_0201  [0201]
R11130  10K  RESISTOR_0201  [0201]
R11131  10K  RESISTOR_0201  [0201]
R11132  10K  RESISTOR_0201  [0201]
R11133  10K  RESISTOR_0201  [0201]
R11134  10K  RESISTOR_0201  [0201]
R11135  10K  RESISTOR_0201  [0201]
R11136  10K  RESISTOR_0201  [0201]
R11137  10K  RESISTOR_0201  [0201]
R11138  10K  RESISTOR_0201  [0201]
R11139  10K  RESISTOR_0201  [0201]
R11140  10K  RESISTOR_0201  [0201]
R11141  10K  RESISTOR_0201  [0201]
R11142  10K  RESISTOR_0201  [0201]
R11143  10K  RESISTOR_0201  [0201]
R11144  10K  RESISTOR_0201  [0201]
R11145  10K  RESISTOR_0201  [0201]
R11146  10K  RESISTOR_0201  [0201]
R11147  10K  RESISTOR_0201  [0201]
R11148  10K  RESISTOR_0201  [0201]
R11149  10K  RESISTOR_0201  [0201]
R11150  10K  RESISTOR_0201  [0201]
R11151  10K  RESISTOR_0201  [0201]
R11152  10K  RESISTOR_0201  [0201]
R11153  10K  RESISTOR_0201  [0201]
R11154  10K  RESISTOR_0201  [0201]
R11155  10K  RESISTOR_0201  [0201]
R11156  10K  RESISTOR_0201  [0201]
R11157  10K  RESISTOR_0201  [0201]
R11158  10K  RESISTOR_0201  [0201]
R11159  10K  RESISTOR_0201  [0201]
R11160  10K  RESISTOR_0201  [0201]
R11161  10K  RESISTOR_0201  [0201]
R11162  10K  RESISTOR_0201  [0201]
R11163  10K  RESISTOR_0201  [0201]
R11164  10K  RESISTOR_0201  [0201]
R11165  10K  RESISTOR_0201  [0201]
R11166  10K  RESISTOR_0201  [0201]
R11167  10K  RESISTOR_0201  [0201]
R11168  10K  RESISTOR_0201  [0201]
R11169  10K  RESISTOR_0201  [0201]
R11170  10K  RESISTOR_0201  [0201]
R11171  10K  RESISTOR_0201  [0201]
R11172  10K  RESISTOR_0201  [0201]
R11173  10K  RESISTOR_0201  [0201]
R11174  10K  RESISTOR_0201  [0201]
R11175  10K  RESISTOR_0201  [0201]
R11176  10K  RESISTOR_0201  [0201]
R11177  10K  RESISTOR_0201  [0201]
R11178  10K  RESISTOR_0201  [0201]
R11179  10K  RESISTOR_0201  [0201]
R11180  10K  RESISTOR_0201  [0201]
R11181  10K  RESISTOR_0201  [0201]
R11182  10K  RESISTOR_0201  [0201]
R11183  10K  RESISTOR_0201  [0201]
R11184  10K  RESISTOR_0201  [0201]
R11185  10K  RESISTOR_0201  [0201]
R11186  10K  RESISTOR_0201  [0201]
R11187  10K  RESISTOR_0201  [0201]
R11188  10K  RESISTOR_0201  [0201]
R11189  10K  RESISTOR_0201  [0201]
R11190  10K  RESISTOR_0201  [0201]
R11191  10K  RESISTOR_0201  [0201]
R11192  10K  RESISTOR_0201  [0201]
R11193  10K  RESISTOR_0201  [0201]
R11194  10K  RESISTOR_0201  [0201]
R11195  10K  RESISTOR_0201  [0201]
R11196  10K  RESISTOR_0201  [0201]
R11197  10K  RESISTOR_0201  [0201]
R11198  10K  RESISTOR_0201  [0201]
R11199  10K  RESISTOR_0201  [0201]
R11200  10K  RESISTOR_0201  [0201]
R11201  10K  RESISTOR_0201  [0201]
R11202  10K  RESISTOR_0201  [0201]
R11203  10K  RESISTOR_0201  [0201]
R11204  10K  RESISTOR_0201  [0201]
R11205  10K  RESISTOR_0201  [0201]
R11206  10K  RESISTOR_0201  [0201]
R11207  10K  RESISTOR_0201  [0201]
R11208  10K  RESISTOR_0201  [0201]
R11209  10K  RESISTOR_0201  [0201]
R11210  10K  RESISTOR_0201  [0201]
R11211  10K  RESISTOR_0201  [0201]
R11212  10K  RESISTOR_0201  [0201]
R11213  10K  RESISTOR_0201  [0201]
R11214  10K  RESISTOR_0201  [0201]
R11215  10K  RESISTOR_0201  [0201]
R11216  10K  RESISTOR_0201  [0201]
R11217  10K  RESISTOR_0201  [0201]
R11218  10K  RESISTOR_0201  [0201]
R11219  10K  RESISTOR_0201  [0201]
R11220  10K  RESISTOR_0201  [0201]
R11221  10K  RESISTOR_0201  [0201]
R11222  10K  RESISTOR_0201  [0201]
R11223  10K  RESISTOR_0201  [0201]
R11224  10K  RESISTOR_0201  [0201]
R11225  10K  RESISTOR_0201  [0201]
R11226  10K  RESISTOR_0201  [0201]
R11227  10K  RESISTOR_0201  [0201]
R11228  10K  RESISTOR_0201  [0201]
R11229  10K  RESISTOR_0201  [0201]
R11230  10K  RESISTOR_0201  [0201]
R11231  10K  RESISTOR_0201  [0201]
R11232  10K  RESISTOR_0201  [0201]
R11233  10K  RESISTOR_0201  [0201]
R11234  10K  RESISTOR_0201  [0201]
R11235  10K  RESISTOR_0201  [0201]
R11236  10K  RESISTOR_0201  [0201]
R11237  10K  RESISTOR_0201  [0201]
R11238  10K  RESISTOR_0201  [0201]
R11239  10K  RESISTOR_0201  [0201]
R11240  10K  RESISTOR_0201  [0201]
R11241  10K  RESISTOR_0201  [0201]
R11242  10K  RESISTOR_0201  [0201]
R11243  10K  RESISTOR_0201  [0201]
R11244  10K  RESISTOR_0201  [0201]
R11245  10K  RESISTOR_0201  [0201]
R11246  10K  RESISTOR_0201  [0201]
R11247  10K  RESISTOR_0201  [0201]
R11248  10K  RESISTOR_0201  [0201]
R11249  10K  RESISTOR_0201  [0201]
R11250  10K  RESISTOR_0201  [0201]
R11251  10K  RESISTOR_0201  [0201]
R11252  10K  RESISTOR_0201  [0201]
R11253  10K  RESISTOR_0201  [0201]
R11254  10K  RESISTOR_0201  [0201]
R11255  10K  RESISTOR_0201  [0201]
R11256  10K  RESISTOR_0201  [0201]
R11257  10K  RESISTOR_0201  [0201]
R11258  10K  RESISTOR_0201  [0201]
R11259  10K  RESISTOR_0201  [0201]
R11260  10K  RESISTOR_0201  [0201]
R11261  10K  RESISTOR_0201  [0201]
R11262  10K  RESISTOR_0201  [0201]
R11263  10K  RESISTOR_0201  [0201]
R11264  10K  RESISTOR_0201  [0201]
R11265  10K  RESISTOR_0201  [0201]
R11266  10K  RESISTOR_0201  [0201]
R11267  10K  RESISTOR_0201  [0201]
R11268  10K  RESISTOR_0201  [0201]
R11269  10K  RESISTOR_0201  [0201]
R11270  10K  RESISTOR_0201  [0201]
R11271  10K  RESISTOR_0201  [0201]
R11272  10K  RESISTOR_0201  [0201]
R11273  10K  RESISTOR_0201  [0201]
R11274  10K  RESISTOR_0201  [0201]
R11275  10K  RESISTOR_0201  [0201]
R11276  10K  RESISTOR_0201  [0201]
R11277  10K  RESISTOR_0201  [0201]
R11278  10K  RESISTOR_0201  [0201]
R11279  10K  RESISTOR_0201  [0201]
R11280  10K  RESISTOR_0201  [0201]
R11281  10K  RESISTOR_0201  [0201]
R11282  10K  RESISTOR_0201  [0201]
R11283  10K  RESISTOR_0201  [0201]
R11284  10K  RESISTOR_0201  [0201]
R11285  10K  RESISTOR_0201  [0201]
R11286  10K  RESISTOR_0201  [0201]
R11287  10K  RESISTOR_0201  [0201]
R11288  10K  RESISTOR_0201  [0201]
R11289  10K  RESISTOR_0201  [0201]
R11290  10K  RESISTOR_0201  [0201]
R11291  10K  RESISTOR_0201  [0201]
R11292  10K  RESISTOR_0201  [0201]
R11293  10K  RESISTOR_0201  [0201]
R11294  10K  RESISTOR_0201  [0201]
R11295  10K  RESISTOR_0201  [0201]
R11296  10K  RESISTOR_0201  [0201]
R11297  10K  RESISTOR_0201  [0201]
R11298  10K  RESISTOR_0201  [0201]
R11299  10K  RESISTOR_0201  [0201]
R11300  10K  RESISTOR_0201  [0201]
R11301  10K  RESISTOR_0201  [0201]
R11302  10K  RESISTOR_0201  [0201]
R11303  10K  RESISTOR_0201  [0201]
R11304  10K  RESISTOR_0201  [0201]
R11305  10K  RESISTOR_0201  [0201]
R11306  10K  RESISTOR_0201  [0201]
R11307  10K  RESISTOR_0201  [0201]
R11308  10K  RESISTOR_0201  [0201]
R11309  10K  RESISTOR_0201  [0201]
R11310  10K  RESISTOR_0201  [0201]
R11311  10K  RESISTOR_0201  [0201]
R11312  10K  RESISTOR_0201  [0201]
R11313  10K  RESISTOR_0201  [0201]
R11314  10K  RESISTOR_0201  [0201]
R11315  10K  RESISTOR_0201  [0201]
R11316  10K  RESISTOR_0201  [0201]
R11317  10K  RESISTOR_0201  [0201]
R11318  10K  RESISTOR_0201  [0201]
R11319  10K  RESISTOR_0201  [0201]
R11320  10K  RESISTOR_0201  [0201]
R11321  10K  RESISTOR_0201  [0201]
R11322  10K  RESISTOR_0201  [0201]
R11323  10K  RESISTOR_0201  [0201]
R11324  10K  RESISTOR_0201  [0201]
R11325  10K  RESISTOR_0201  [0201]
R11326  10K  RESISTOR_0201  [0201]
R11327  10K  RESISTOR_0201  [0201]
R11328  10K  RESISTOR_0201  [0201]
R11329  10K  RESISTOR_0201  [0201]
R11330  10K  RESISTOR_0201  [0201]
R11331  10K  RESISTOR_0201  [0201]
R11332  10K  RESISTOR_0201  [0201]
R11333  10K  RESISTOR_0201  [0201]
R11334  10K  RESISTOR_0201  [0201]
R11335  10K  RESISTOR_0201  [0201]
R11336  10K  RESISTOR_0201  [0201]
R11337  10K  RESISTOR_0201  [0201]
R11338  10K  RESISTOR_0201  [0201]
R11339  10K  RESISTOR_0201  [0201]
R11340  10K  RESISTOR_0201  [0201]
R11341  10K  RESISTOR_0201  [0201]
R11342  10K  RESISTOR_0201  [0201]
R11343  10K  RESISTOR_0201  [0201]
R11344  10K  RESISTOR_0201  [0201]
R11345  10K  RESISTOR_0201  [0201]
R11346  10K  RESISTOR_0201  [0201]
R11347  10K  RESISTOR_0201  [0201]
R11348  10K  RESISTOR_0201  [0201]
R11349  10K  RESISTOR_0201  [0201]
R11350  10K  RESISTOR_0201  [0201]
R11351  10K  RESISTOR_0201  [0201]
R11352  10K  RESISTOR_0201  [0201]
R11353  10K  RESISTOR_0201  [0201]
R11354  10K  RESISTOR_0201  [0201]
R11355  10K  RESISTOR_0201  [0201]
R11356  10K  RESISTOR_0201  [0201]
R11357  10K  RESISTOR_0201  [0201]
R11358  10K  RESISTOR_0201  [0201]
R11359  10K  RESISTOR_0201  [0201]
R11360  10K  RESISTOR_0201  [0201]
R11361  10K  RESISTOR_0201  [0201]
R11362  10K  RESISTOR_0201  [0201]
R11363  10K  RESISTOR_0201  [0201]
R11364  10K  RESISTOR_0201  [0201]
R11365  10K  RESISTOR_0201  [0201]
R11366  10K  RESISTOR_0201  [0201]
R11367  10K  RESISTOR_0201  [0201]
R11368  10K  RESISTOR_0201  [0201]
R11369  10K  RESISTOR_0201  [0201]
R11370  10K  RESISTOR_0201  [0201]
R11371  10K  RESISTOR_0201  [0201]
R11372  10K  RESISTOR_0201  [0201]
R11373  10K  RESISTOR_0201  [0201]
R11374  10K  RESISTOR_0201  [0201]
R11375  10K  RESISTOR_0201  [0201]
R11376  10K  RESISTOR_0201  [0201]
R11377  10K  RESISTOR_0201  [0201]
R11378  10K  RESISTOR_0201  [0201]
R11379  10K  RESISTOR_0201  [0201]
R11380  10K  RESISTOR_0201  [0201]
R11381  10K  RESISTOR_0201  [0201]
R11382  10K  RESISTOR_0201  [0201]
R11383  10K  RESISTOR_0201  [0201]
R11384  10K  RESISTOR_0201  [0201]
R11385  10K  RESISTOR_0201  [0201]
R11386  10K  RESISTOR_0201  [0201]
R11387  10K  RESISTOR_0201  [0201]
R11388  10K  RESISTOR_0201  [0201]
R11389  10K  RESISTOR_0201  [0201]
R11390  10K  RESISTOR_0201  [0201]
R11391  10K  RESISTOR_0201  [0201]
R11392  10K  RESISTOR_0201  [0201]
R11393  10K  RESISTOR_0201  [0201]
R11394  10K  RESISTOR_0201  [0201]
R11395  10K  RESISTOR_0201  [0201]
R11396  10K  RESISTOR_0201  [0201]
R11397  10K  RESISTOR_0201  [0201]
R11398  10K  RESISTOR_0201  [0201]
R11399  10K  RESISTOR_0201  [0201]
R11400  10K  RESISTOR_0201  [0201]
R11401  10K  RESISTOR_0201  [0201]
R11402  10K  RESISTOR_0201  [0201]
R11403  10K  RESISTOR_0201  [0201]
R11404  10K  RESISTOR_0201  [0201]
R11405  10K  RESISTOR_0201  [0201]
R11406  10K  RESISTOR_0201  [0201]
R11407  10K  RESISTOR_0201  [0201]
R11408  10K  RESISTOR_0201  [0201]
R11409  10K  RESISTOR_0201  [0201]
R11410  10K  RESISTOR_0201  [0201]
R11411  10K  RESISTOR_0201  [0201]
R11412  10K  RESISTOR_0201  [0201]
R11413  10K  RESISTOR_0201  [0201]
R11414  10K  RESISTOR_0201  [0201]
R11415  10K  RESISTOR_0201  [0201]
R11416  10K  RESISTOR_0201  [0201]
R11417  10K  RESISTOR_0201  [0201]
R11418  10K  RESISTOR_0201  [0201]
R11419  10K  RESISTOR_0201  [0201]
R11420  10K  RESISTOR_0201  [0201]
R11421  10K  RESISTOR_0201  [0201]
R11422  10K  RESISTOR_0201  [0201]
R11423  10K  RESISTOR_0201  [0201]
R11424  10K  RESISTOR_0201  [0201]
R11425  10K  RESISTOR_0201  [0201]
R11426  10K  RESISTOR_0201  [0201]
R11427  10K  RESISTOR_0201  [0201]
R11428  10K  RESISTOR_0201  [0201]
R11429  10K  RESISTOR_0201  [0201]
R11430  10K  RESISTOR_0201  [0201]
R11431  10K  RESISTOR_0201  [0201]
R11432  10K  RESISTOR_0201  [0201]
R11433  10K  RESISTOR_0201  [0201]
R11434  10K  RESISTOR_0201  [0201]
R11435  10K  RESISTOR_0201  [0201]
R11436  10K  RESISTOR_0201  [0201]
R11437  10K  RESISTOR_0201  [0201]
R11438  10K  RESISTOR_0201  [0201]
R11439  10K  RESISTOR_0201  [0201]
R11440  10K  RESISTOR_0201  [0201]
R11441  10K  RESISTOR_0201  [0201]
R11442  10K  RESISTOR_0201  [0201]
R11443  10K  RESISTOR_0201  [0201]
R11444  10K  RESISTOR_0201  [0201]
R11445  10K  RESISTOR_0201  [0201]
R11446  10K  RESISTOR_0201  [0201]
R11447  10K  RESISTOR_0201  [0201]
R11448  10K  RESISTOR_0201  [0201]
R11449  10K  RESISTOR_0201  [0201]
R11450  10K  RESISTOR_0201  [0201]
R11451  10K  RESISTOR_0201  [0201]
R11452  10K  RESISTOR_0201  [0201]
R11453  10K  RESISTOR_0201  [0201]
R11454  10K  RESISTOR_0201  [0201]
R11455  10K  RESISTOR_0201  [0201]
R11456  10K  RESISTOR_0201  [0201]
R11457  10K  RESISTOR_0201  [0201]
R11458  10K  RESISTOR_0201  [0201]
R11459  10K  RESISTOR_0201  [0201]
R11460  10K  RESISTOR_0201  [0201]
R11461  10K  RESISTOR_0201  [0201]
R11462  10K  RESISTOR_0201  [0201]
R11463  10K  RESISTOR_0201  [0201]
R11464  10K  RESISTOR_0201  [0201]
R11465  10K  RESISTOR_0201  [0201]
R11466  10K  RESISTOR_0201  [0201]
R11467  10K  RESISTOR_0201  [0201]
R11468  10K  RESISTOR_0201  [0201]
R11469  10K  RESISTOR_0201  [0201]
R11470  10K  RESISTOR_0201  [0201]
R11471  10K  RESISTOR_0201  [0201]
R11472  10K  RESISTOR_0201  [0201]
R11473  10K  RESISTOR_0201  [0201]
R11474  10K  RESISTOR_0201  [0201]
R11475  10K  RESISTOR_0201  [0201]
R11476  10K  RESISTOR_0201  [0201]
R11477  10K  RESISTOR_0201  [0201]
R11478  10K  RESISTOR_0201  [0201]
R11479  10K  RESISTOR_0201  [0201]
R11480  10K  RESISTOR_0201  [0201]
R11481  10K  RESISTOR_0201  [0201]
R11482  10K  RESISTOR_0201  [0201]
R11483  10K  RESISTOR_0201  [0201]
R11484  10K  RESISTOR_0201  [0201]
R11485  10K  RESISTOR_0201  [0201]
R11486  10K  RESISTOR_0201  [0201]
R11487  10K  RESISTOR_0201  [0201]
R11488  10K  RESISTOR_0201  [0201]
R11489  10K  RESISTOR_0201  [0201]
R11490  10K  RESISTOR_0201  [0201]
R11491  10K  RESISTOR_0201  [0201]
R11492  10K  RESISTOR_0201  [0201]
R11493  10K  RESISTOR_0201  [0201]
R11494  10K  RESISTOR_0201  [0201]
R11495  10K  RESISTOR_0201  [0201]
R11496  10K  RESISTOR_0201  [0201]
R11497  10K  RESISTOR_0201  [0201]
R11498  10K  RESISTOR_0201  [0201]
R11499  10K  RESISTOR_0201  [0201]
R11500  10K  RESISTOR_0201  [0201]
R11501  10K  RESISTOR_0201  [0201]
R11502  10K  RESISTOR_0201  [0201]
R11503  10K  RESISTOR_0201  [0201]
R11504  10K  RESISTOR_0201  [0201]
R11505  10K  RESISTOR_0201  [0201]
R11506  10K  RESISTOR_0201  [0201]
R11507  10K  RESISTOR_0201  [0201]
R11508  10K  RESISTOR_0201  [0201]
R11509  10K  RESISTOR_0201  [0201]
R11510  10K  RESISTOR_0201  [0201]
R11511  10K  RESISTOR_0201  [0201]
R11512  10K  RESISTOR_0201  [0201]
R11513  10K  RESISTOR_0201  [0201]
R11514  10K  RESISTOR_0201  [0201]
R11515  10K  RESISTOR_0201  [0201]
R11516  10K  RESISTOR_0201  [0201]
R11517  10K  RESISTOR_0201  [0201]
R11518  10K  RESISTOR_0201  [0201]
R11519  10K  RESISTOR_0201  [0201]
R11520  10K  RESISTOR_0201  [0201]
R11521  10K  RESISTOR_0201  [0201]
R11522  10K  RESISTOR_0201  [0201]
R11523  10K  RESISTOR_0201  [0201]
R11524  10K  RESISTOR_0201  [0201]
R11525  10K  RESISTOR_0201  [0201]
R11526  10K  RESISTOR_0201  [0201]
R11527  10K  RESISTOR_0201  [0201]
R11528  10K  RESISTOR_0201  [0201]
R11529  10K  RESISTOR_0201  [0201]
R11530  10K  RESISTOR_0201  [0201]
R11531  10K  RESISTOR_0201  [0201]
R11532  10K  RESISTOR_0201  [0201]
R11533  10K  RESISTOR_0201  [0201]
R11534  10K  RESISTOR_0201  [0201]
R11535  10K  RESISTOR_0201  [0201]
R11536  10K  RESISTOR_0201  [0201]
R11537  10K  RESISTOR_0201  [0201]
R11538  10K  RESISTOR_0201  [0201]
R11539  10K  RESISTOR_0201  [0201]
R11540  10K  RESISTOR_0201  [0201]
R11541  10K  RESISTOR_0201  [0201]
R11542  10K  RESISTOR_0201  [0201]
R11543  10K  RESISTOR_0201  [0201]
R11544  10K  RESISTOR_0201  [0201]
R11545  10K  RESISTOR_0201  [0201]
R11546  10K  RESISTOR_0201  [0201]
R11547  10K  RESISTOR_0201  [0201]
R11548  10K  RESISTOR_0201  [0201]
R11549  10K  RESISTOR_0201  [0201]
R11550  10K  RESISTOR_0201  [0201]
R11551  10K  RESISTOR_0201  [0201]
R11552  10K  RESISTOR_0201  [0201]
R11553  10K  RESISTOR_0201  [0201]
R11554  10K  RESISTOR_0201  [0201]
R11555  10K  RESISTOR_0201  [0201]
R11556  10K  RESISTOR_0201  [0201]
R11557  10K  RESISTOR_0201  [0201]
R11558  10K  RESISTOR_0201  [0201]
R11559  10K  RESISTOR_0201  [0201]
R11560  10K  RESISTOR_0201  [0201]
R11561  10K  RESISTOR_0201  [0201]
R11562  10K  RESISTOR_0201  [0201]
R11563  10K  RESISTOR_0201  [0201]
R11564  10K  RESISTOR_0201  [0201]
R11565  10K  RESISTOR_0201  [0201]
R11566  10K  RESISTOR_0201  [0201]
R11567  10K  RESISTOR_0201  [0201]
R11568  10K  RESISTOR_0201  [0201]
R11569  10K  RESISTOR_0201  [0201]
R11570  10K  RESISTOR_0201  [0201]
R11571  10K  RESISTOR_0201  [0201]
R11572  10K  RESISTOR_0201  [0201]
R11573  10K  RESISTOR_0201  [0201]
R11574  10K  RESISTOR_0201  [0201]
R11575  10K  RESISTOR_0201  [0201]
R11576  10K  RESISTOR_0201  [0201]
R11577  10K  RESISTOR_0201  [0201]
R11578  10K  RESISTOR_0201  [0201]
R11579  10K  RESISTOR_0201  [0201]
R11580  10K  RESISTOR_0201  [0201]
R11581  10K  RESISTOR_0201  [0201]
R11582  10K  RESISTOR_0201  [0201]
R11583  10K  RESISTOR_0201  [0201]
R11584  10K  RESISTOR_0201  [0201]
R11585  10K  RESISTOR_0201  [0201]
R11586  10K  RESISTOR_0201  [0201]
R11587  10K  RESISTOR_0201  [0201]
R11588  10K  RESISTOR_0201  [0201]
R11589  10K  RESISTOR_0201  [0201]
R11590  10K  RESISTOR_0201  [0201]
R11591  10K  RESISTOR_0201  [0201]
R11592  10K  RESISTOR_0201  [0201]
R11593  10K  RESISTOR_0201  [0201]
R11594  10K  RESISTOR_0201  [0201]
R11595  10K  RESISTOR_0201  [0201]
R11596  10K  RESISTOR_0201  [0201]
R11597  10K  RESISTOR_0201  [0201]
R11598  10K  RESISTOR_0201  [0201]
R11599  10K  RESISTOR_0201  [0201]
R11600  10K  RESISTOR_0201  [0201]
R11601  10K  RESISTOR_0201  [0201]
R11602  10K  RESISTOR_0201  [0201]
R11603  10K  RESISTOR_0201  [0201]
R11604  10K  RESISTOR_0201  [0201]
R11605  10K  RESISTOR_0201  [0201]
R11606  10K  RESISTOR_0201  [0201]
R11607  10K  RESISTOR_0201  [0201]
R11608  10K  RESISTOR_0201  [0201]
R11609  10K  RESISTOR_0201  [0201]
R11610  10K  RESISTOR_0201  [0201]
R11611  10K  RESISTOR_0201  [0201]
R11612  10K  RESISTOR_0201  [0201]
R11613  10K  RESISTOR_0201  [0201]
R11614  10K  RESISTOR_0201  [0201]
R11615  10K  RESISTOR_0201  [0201]
R11616  10K  RESISTOR_0201  [0201]
R11617  10K  RESISTOR_0201  [0201]
R11618  10K  RESISTOR_0201  [0201]
R11619  10K  RESISTOR_0201  [0201]
R11620  10K  RESISTOR_0201  [0201]
R11621  10K  RESISTOR_0201  [0201]
R11622  10K  RESISTOR_0201  [0201]
R11623  10K  RESISTOR_0201  [0201]
R11624  10K  RESISTOR_0201  [0201]
R11625  10K  RESISTOR_0201  [0201]
R11626  10K  RESISTOR_0201  [0201]
R11627  10K  RESISTOR_0201  [0201]
R11628  10K  RESISTOR_0201  [0201]
R11629  10K  RESISTOR_0201  [0201]
R11630  10K  RESISTOR_0201  [0201]
R11631  10K  RESISTOR_0201  [0201]
R11632  10K  RESISTOR_0201  [0201]
R11633  10K  RESISTOR_0201  [0201]
R11634  10K  RESISTOR_0201  [0201]
R11635  10K  RESISTOR_0201  [0201]
R11636  10K  RESISTOR_0201  [0201]
R11637  10K  RESISTOR_0201  [0201]
R11638  10K  RESISTOR_0201  [0201]
R11639  10K  RESISTOR_0201  [0201]
R11640  10K  RESISTOR_0201  [0201]
R11641  10K  RESISTOR_0201  [0201]
R11642  10K  RESISTOR_0201  [0201]
R11643  10K  RESISTOR_0201  [0201]
R11644  10K  RESISTOR_0201  [0201]
R11645  10K  RESISTOR_0201  [0201]
R11646  10K  RESISTOR_0201  [0201]
R11647  10K  RESISTOR_0201  [0201]
R11648  10K  RESISTOR_0201  [0201]
R11649  10K  RESISTOR_0201  [0201]
R11650  10K  RESISTOR_0201  [0201]
R11651  10K  RESISTOR_0201  [0201]
R11652  10K  RESISTOR_0201  [0201]
R11653  10K  RESISTOR_0201  [0201]
R11654  10K  RESISTOR_0201  [0201]
R11655  10K  RESISTOR_0201  [0201]
R11656  10K  RESISTOR_0201  [0201]
R11657  10K  RESISTOR_0201  [0201]